# EAGLE board yrl040-bugfix1 (EAGLE 9.4.2), part 2 of 2
## Tracks (layer width: path | path; a pad name or v marks a point on that pad's centre or on a via) (continued)
LED_TX  (via drill 0.35 pad 0.65) (continued)
  Bottom 0.15: IC1.22 v45.8,71.75 | v45.8,71.75 | v15.4,84.9 14.6,84.1 14.6,83.7 15.44,82.86 17.39,82.86 17.52,82.73 17.52,81.19 17.39,81.06 13.34,81.06 12.78,80.5 12.1,80.5 11.4,79.8 11.4,79.75 11.1,79.45 11.1,77.32 11.31,77.1 11.31,76.64 11.4,76.55 11.4,75.6 10.5,74.7 10.5,70.9 11.7,69.7 14.4,69.7 14.43,69.72 15.39,69.72 16.14,70.47 17.09,70.47 17.23,70.61 17.23,71.29 16.79,71.72 16.62,71.72 LED10.2_RED-CATHODE
MISO
  Top 0.15: J19.MISO 10.91,84.5 10.01,85.4 9.26,85.4 8.74,84.87 8.74,84.84 7.4,83.5 6.79,83.5 5.47,82.17 3.17,82.17 0.62,79.62 0.62,59.15 1.73,58.05 1.73,56.62 1.23,56.12 1.23,50.35 1.87,49.7 11,49.7 11.55,49.15 11.55,48.08 10.88,47.42 10.88,46.66 10.06,45.83 J1.MISO
MOSI
  Top 0.15: J19.MOSI 13.08,82.86 13.08,84.87 12.45,85.5 10.33,85.5 10.13,85.7 9.14,85.7 8.94,85.5 6.5,85.5 5.92,84.92 5.92,83.92 5.47,83.47 5.47,82.61 5.34,82.47 3.05,82.47 0.33,79.75 0.33,59.03 1.43,57.93 1.43,56.75 0.93,56.25 0.93,49.7 1.22,49.4 3.02,49.4 4.92,47.5 6.7,47.5 7.2,47 7.2,46.62 7.65,46.17 8.8,46.17 8.87,46.25 9.31,46.25 J1.MOSI
MOTOR_FAULT_LED_C
  Bottom 0.15: 44.5,40.98 44.76,40.73 45.94,40.73 46.08,40.86 46.08,40.98 47.7,42.6 49.05,42.6
  Bottom 0.2: R27.1 49.05,42.6 | U13.19 33.23,39.33 34.1,40.2 34.1,41.9 36.68,44.48 39.12,44.48 39.25,44.35 43,44.35 43.45,43.9 43.45,42.8 43.95,42.3 44.25,42.3 44.5,42.05 44.5,40.98
N$1
  Bottom 0.15: LED1.ANODE 17.77,13.78 17.56,13.78 16.82,13.03 16.82,10.46 17.62,9.65 26.21,9.65 27.08,10.53 27.09,10.53 27.64,11.07 34.5,11.07 34.51,11.08 35,11.08 RA5.P$8
N$2
  Bottom 0.15: RA5.P$7 33.84,12.06 33.84,12.19 33.4,12.62 32.17,12.62 31.65,12.1 27.94,12.1 27.61,12.42 27.61,14.37 26.96,15.03 22.41,15.03 21.48,14.1 LED2.ANODE
N$3
  Bottom 0.15: RA5.P$6 33.03,12.06 33.03,12.19 32.9,12.32 32.3,12.32 31.77,11.8 27.82,11.8 27.32,12.3 27.32,14.24 26.83,14.72 24.65,14.72 24.02,14.1 LED3.ANODE
N$4
  Bottom 0.15: LED4.ANODE 26.07,13.78 26.27,13.78 27.02,13.03 27.02,11.79 27.3,11.5 32.4,11.5 RA5.P$5
N$5
  Bottom 0.15: R4.2 13.8,12 13.5,11.7 13.5,11.06 13.22,10.79 12.25,10.79 U3.3
N$6
  Bottom 0.15: R5.2 14.35,8.71 14.95,9.31 14.95,10.89 14.82,11.03 14.08,11.03 13.36,10.3 13.36,10.26 13.22,10.13 12.23,10.13 U3.4
N$7
  Bottom 0.15: R4.1 C4.2
N$8
  Bottom 0.15: R5.1 C5.2
N$9
  Bottom 0.15: C5.1 13.05,8.2 R2.2 C2.2 11.55,5.3 R1.2
N$10
  Bottom 0.35: U3.5 7.42,9.94 6.93,9.45 5.37,9.45 4.92,9.9 X1.1
N$11
  Bottom 0.29: U7.2 7.02,33.11 7.03,33.1 5.68,33.1 R11.2
  Bottom 1.016: R11.2 R13.2
N$12
  Top 0.508: J8.P1-A J8.P1-B J8.P1-C
  Bottom 0.29: U7.1 7.5,34.83 7.86,34.47 J8.P1-B
N$13
  Top 0.508: J8.P2-A J8.P2-B J8.P2-C
  Bottom 0.406: U7.3 6.51,37.08 6.37,36.94 4.18,36.94 J8.P2-A
N$14
  Bottom 0.29: U8.2 7.02,18.87 7.03,18.86 5.68,18.86 R12.2
  Bottom 1.016: R12.2 R14.2
N$15
  Top 0.508: J9.P1-A J9.P1-B J9.P1-C
  Bottom 0.29: U8.1 7.5,20.59 7.86,20.23 J9.P1-B
N$16
  Top 0.508: J9.P2-A J9.P2-B J9.P2-C
  Bottom 0.406: U8.3 6.51,22.84 6.37,22.7 4.18,22.7 J9.P2-A
N$17
  Bottom 0.35: U3.8 7.42,11.87 6.93,12.35 5.37,12.35 4.92,11.9 X1.2
N$18
  Bottom 0.15: MIC1.1 15.7,17.96 R8.2
N$19
  Bottom 0.15: MIC1.4 10.15,17.05 10.04,16.94 10.04,14.69 R9.2
N$20
  Bottom 0.15: U5.6 24.27,50.16 24.5,50.4 29.27,50.4 29.51,50.16 29.64,50.16 RA6.P$1
N$21
  Bottom 1.5: J7.V_EXT 27.5,65.43 27.48,65.41 27.48,64.39 27.5,64.37 J7.V_INT_JUMPER J7.V+4 J7.V+3 J7.V+2 18.43,63.5 18.41,63.48 17.39,63.48 17.37,63.5 J7.V+1
N$22
  Bottom 1.5: J7.V+5 J7.V+6 J7.V+7 J7.V+8 J7.V_INT_JUMPER1 J7.V_EXT1
N$23
  Bottom 0.29: U9.2 48.88,25.29 48.87,25.3 50.22,25.3 R15.2
  Bottom 1.016: R15.2 R17.2
N$24
  Top 0.508: J16.P1-A J16.P1-B J16.P1-C
  Bottom 0.29: U9.1 48.4,23.57 48.04,23.93 J16.P1-B
N$25
  Top 0.508: J16.P2-A J16.P2-B J16.P2-C
  Bottom 0.406: U9.3 49.39,21.32 49.53,21.46 51.72,21.46 J16.P2-A
N$26
  Bottom 0.29: U10.2 48.88,39.53 48.87,39.54 50.22,39.54 R16.2
  Bottom 1.016: R16.2 R18.2
N$27
  Top 0.508: J17.P1-A J17.P1-B J17.P1-C
  Bottom 0.29: U10.1 48.4,37.81 48.04,38.17 J17.P1-B
N$28
  Top 0.508: J17.P2-A J17.P2-B J17.P2-C
  Bottom 0.406: U10.3 49.39,35.56 49.53,35.7 51.72,35.7 J17.P2-A
N$29
  Bottom 0.15: U5.7 23.6,49.41 23.6,50.4 23.9,50.7 29.5,50.7 29.6,50.6 RA6.P$2
N$30
  Bottom 0.15: U5.8 22.97,50.5 23.47,51 29.47,51 29.51,51.03 29.64,51.03 RA6.P$3
N$31
  Bottom 0.15: U5.9 22.57,49.61 22.57,50.52 23.35,51.3 28.97,51.3 29.87,52.2 RA6.P$4
N$32  (via drill 0.35 pad 0.65)
  Top 0.15: J7.PWM4 24.95,66.7 24.95,66.92 26.5,68.47 28.78,68.47 29.8,67.45 31.42,67.45 31.86,67.89 37.76,67.89 39.22,66.43 39.22,60.15 39.06,60 32.88,60 31.8,58.92 31.8,57.18 32.85,56.13 32.85,52.45 v32.6,52.2
  Bottom 0.15: v32.6,52.2 RA6.P$5
N$33
  Bottom 0.15: MIC1.6 14.15,18.55 R10.1
N$34  (via drill 0.35 pad 0.65)
  Top 0.15: v32.6,51.4 33.15,51.95 33.15,56.25 32.1,57.3 32.1,58.8 33,59.7 39.19,59.7 39.52,60.03 39.52,66.55 37.88,68.19 31.74,68.19 31.3,67.75 29.92,67.75 28.91,68.77 25.71,68.77 22.94,66 21.81,66 J7.PWM3
  Bottom 0.15: v32.6,51.4 RA6.P$6
N$35  (via drill 0.35 pad 0.65)
  Top 0.15: v32.6,50.6 32.7,50.7 32.7,50.72 33.45,51.47 33.45,56.71 34.14,57.4 34.14,58.84 34.7,59.4 39.31,59.4 39.82,59.91 39.82,66.68 38.01,68.49 31.61,68.49 31.17,68.05 30.05,68.05 29.03,69.06 23.47,69.06 20.44,66.04 J7.PWM2
  Bottom 0.15: v32.6,50.6 RA6.P$7
N$36  (via drill 0.35 pad 0.65)
  Top 0.15: v32.6,49.8 32.6,49.82 33.75,50.97 33.75,56.59 34.44,57.27 34.44,58.71 34.82,59.1 39.44,59.1 40.12,59.78 40.12,66.8 38.12,68.8 31.5,68.8 31.05,68.35 30.17,68.35 29.16,69.36 21.07,69.36 18.35,66.65 18.35,66.57 17.82,66.04 J7.PWM1
  Bottom 0.15: v32.6,49.8 RA6.P$8
N$37
  Bottom 0.15: U5.10 21.42,49.64 21.42,50.21 20.33,51.3 18.4,51.3 18,51.7 RA7.P$1
N$38
  Bottom 0.15: U5.11 21.01,50.11 20.12,51 17.4,51 RA7.P$2
N$39
  Bottom 0.15: U5.12 20.38,50.32 20,50.7 18.75,50.7 18.38,50.33 18.38,50.2 18.28,50.1 RA7.P$3
N$40
  Bottom 0.15: U5.13 19.72,50.28 19.6,50.4 18.87,50.4 18.68,50.21 18.68,49.48 18.5,49.3 RA7.P$4
N$41  (via drill 0.35 pad 0.65)
  Top 0.15: J7.PWM8 37.42,65.18 36.21,65.18 35.53,64.5 30.02,64.5 28.73,65.8 28.73,66.55 28.01,67.27 26.99,67.27 26.27,66.55 26.27,65.41 25.25,64.38 25.25,63.11 24.7,62.56 19.05,62.56 18.7,62.21 18.7,62.17 18.29,61.77 18.29,57.4 19.3,56.39 19.3,52.4 18.15,51.25 16.45,51.25 v14.5,49.3
  Bottom 0.15: v14.5,49.3 RA7.P$5
N$42  (via drill 0.35 pad 0.65)
  Top 0.15: v14.5,50.1 16.05,51.65 17.95,51.65 19,52.7 19,56.27 17.99,57.27 17.99,61.89 18.29,62.19 18.29,63.89 18.84,64.44 19.04,64.44 19.1,64.5 24.95,64.5 25.85,65.4 25.85,66.54 26.87,67.56 28.13,67.56 29.02,66.67 29.02,66.25 29.04,66.24 29.04,65.91 30.15,64.8 34.5,64.8 J7.PWM7
  Bottom 0.15: v14.5,50.1 RA7.P$6
N$43  (via drill 0.35 pad 0.65)
  Top 0.15: v14.5,50.9 15.5,51.9 15.5,63.64 16.67,64.8 17.23,64.8 17.67,65.25 18.13,65.25 18.57,64.8 24.82,64.8 25.55,65.53 25.55,66.67 26.74,67.86 28.34,67.86 29.72,66.48 29.72,65.65 30.27,65.1 32.26,65.1 J7.PWM6
  Bottom 0.15: v14.5,50.9 RA7.P$7
N$44  (via drill 0.35 pad 0.65)
  Top 0.15: v14.5,51.7 14.85,52.05 14.85,56.98 15.02,57.15 15.02,63.58 16.54,65.1 17.1,65.1 17.55,65.55 18.25,65.55 18.7,65.1 24.7,65.1 25.25,65.65 25.25,66.79 26.62,68.17 28.66,68.17 29.68,67.15 30.2,67.15 30.66,66.69 J7.PWM5
  Bottom 0.15: v14.5,51.7 RA7.P$8
N$45
  Bottom 0.15: RA8.P$4 17.95,56.25 20.38,56.25 20.62,56.48 23.01,56.48 J7.PWM12
N$46
  Bottom 0.15: RA8.P$3 16.7,56.25 17,56.55 20.26,56.55 20.49,56.78 20.77,56.78 J7.PWM11
N$47
  Bottom 0.15: J7.PWM10 18.02,57.78 17.08,56.85 16.5,56.85 15.9,56.25 RA8.P$2
N$48
  Bottom 0.15: J7.PWM9 15.98,57.78 15.1,56.9 RA8.P$1
N$49
  Bottom 0.15: U5.15 17.85,55.22 17.8,55.17 15.38,55.17 15.1,54.9 RA8.P$8
N$50
  Bottom 0.15: U5.16 19.49,54.99 19.49,54.39 19.36,54.26 18.81,54.26 18.68,54.39 18.68,54.82 18.6,54.9 17.95,54.9 17.93,54.88 16.18,54.88 15.9,54.6 RA8.P$7
N$51
  Bottom 0.15: U5.17 20.61,55.45 20.61,56.05 20.74,56.18 24.03,56.18 25.25,57.4 25.25,58.17 24.7,58.72 16.3,58.72 14.8,57.22 14.8,56.43 14.66,56.29 14.66,53.51 14.8,53.38 16.2,53.38 16.34,53.51 16.34,53.63 RA8.P$6
N$52
  Bottom 0.15: U5.18 20.78,54.99 20.78,54.39 20.35,53.96 18.69,53.96 18.65,54 RA8.P$5
N$53
  Bottom 0.15: RA9.P$4 32.85,56.55 35.83,56.55 37.07,57.78 J7.PWM16
N$54
  Bottom 0.15: RA9.P$3 31.86,56.37 31.86,56.49 32.22,56.85 33.59,56.85 34.53,57.78 J7.PWM15
N$55
  Bottom 0.15: RA9.P$2 31.07,56.37 31.07,56.49 32.36,57.78 J7.PWM14
N$56
  Bottom 0.15: RA9.P$1 29.9,57.02 J7.PWM13
N$57
  Bottom 0.15: U5.19 21.67,53.63 22.47,52.83 22.95,52.83 22.97,52.85 23.43,52.85 23.45,52.83 24.57,52.83 24.87,52.53 27.63,52.53 27.93,52.83 28.53,52.83 RA9.P$8
N$58
  Bottom 0.15: RA9.P$7 30.34,54.56 30.34,54.69 30.2,54.83 29.6,54.83 29.46,54.69 29.46,54.19 28.41,53.13 27.8,53.13 27.5,52.83 25,52.83 24.7,53.13 23.57,53.13 23.55,53.15 22.85,53.15 22.34,53.66 U5.20
N$59
  Bottom 0.15: RA9.P$6 31.14,54.56 31.14,54.69 30.86,54.96 30.49,54.96 30.33,55.12 29.47,55.12 29.16,54.82 29.16,54.31 28.28,53.43 27.68,53.43 27.38,53.13 25.12,53.13 24.82,53.43 23.69,53.43 23.68,53.45 23.55,53.45 22.97,54.03 U5.21
N$60
  Bottom 0.15: RA9.P$5 32.73,54.63 32.73,56 32.98,56.25 35.95,56.25 36.55,56.85 38.67,56.85 39.22,57.4 39.22,58.17 38.67,58.72 30.27,58.72 28.86,57.32 28.86,54.66 27.93,53.73 27.56,53.73 27.26,53.43 25.24,53.43 24.94,53.73 24.07,53.73 23.63,54.17 U5.22
N$61
  Bottom 0.15: U13.4 36.88,40.88 37.45,40.88 38.63,42.06 J22.GPIO0
N$62  (via drill 0.35 pad 0.65)
  Top 0.15: v37.59,40.01 37.59,41.09 38.2,41.7 39.69,41.7 J22.GPIO1
  Bottom 0.15: U13.5 37.55,39.97 v37.59,40.01
N$63
  Bottom 0.15: U13.6 36.65,39.3 37.66,39.3 38.63,40.27 J22.GPIO2
N$64
  Bottom 0.15: U13.7 37.87,38.67 38.24,39.04 39.57,39.04 J22.GPIO3
N$65
  Bottom 0.15: J22.GPIO4 38.56,38.03 U13.8
N$66
  Bottom 0.15: J22.GPIO5 40.23,37.16 38.24,37.16 38.03,37.37 U13.9
N$67
  Bottom 0.15: U13.10 37.89,36.71 38.63,35.97 J22.GPIO6
N$68
  Bottom 0.15: J22.GPIO7 40.23,34.62 38.24,34.62 37.69,35.17 37.69,35.9 37.51,36.08 U13.11
N$69
  Bottom 0.9: F2.1 42.2,60.77 J7.+5V1
N$70
  Bottom 0.6: J7.+5V 28.3,60.7 F1.1
N$71
  Bottom 0.2: R27.2 48.65,43.9 LED8.CATHODE
N$72
  Bottom 0.152: R25.2 51.45,53.48 51.1,53.48 50.9,53.48 LED7.CATHODE
N$73
  Bottom 0.152: R25.1 52.96,53.29 Q1.3-D
  Bottom 1.016: Q1.3-D 51.87,51.85 51.29,51.85 50.54,51.1 J23.V-
N$74
  Bottom 0.2: LED7.ANODE 47.26,51.47 J23.V+
  Bottom 0.813: F4.2 49.4,49.33 J23.V+
N$75
  Bottom 0.152: R31.2 43.25,53.48 LED12.CATHODE
N$76
  Bottom 0.152: R31.1 44.96,53.49 Q2.3-D
  Bottom 1.016: Q2.3-D 43.87,51.85 43.29,51.85 42.54,51.1 J24.V-
N$77
  Bottom 0.2: LED12.ANODE 39.26,51.47 J24.V+
  Bottom 0.813: F5.2 41.4,49.33 J24.V+
N$78
  Bottom 0.2: RA11.P$6 6,66.6 6.55,66.6 7.26,67.31 7.83,67.31 7.97,67.16 7.97,66.55 U14.9
N$79
  Bottom 0.2: U14.10 8.63,66.53 8.63,67.16 8.14,67.66 6.56,67.66 6.21,67.3 RA11.P$5
N$80
  Bottom 0.2: U14.11 9.4,66.42 9.4,67.03 8.42,68.01 7.69,68.01 RA12.P$8
N$81
  Bottom 0.2: U14.12 10.16,66.93 8.94,68.14 8.78,68.14 8.57,68.36 7.84,68.36 6.55,69.64 6.55,70.11 6.4,70.26 6.24,70.26 RA12.P$7
N$82
  Bottom 0.2: U14.13 10.79,66.95 9.38,68.38 9.28,68.47 9.11,68.47 8.88,68.71 7.98,68.71 6.9,69.79 6.9,70.56 6.06,71.4 RA12.P$6
N$83
  Bottom 0.2: U14.14 11.46,66.93 9.33,69.06 8.13,69.06 7.25,69.94 7.25,70.9 6.69,71.46 6.69,71.69 6.18,72.2 RA12.P$5
N$84
  Bottom 0.2: U14.8 6.92,65.7 RA11.P$7
N$85
  Bottom 0.15: U15.27 9.2,49.69 9.2,49.51 9.04,49.35 7.95,49.35 7.75,49.55 7.75,49.9 7.7,49.9 6.6,51 6.6,51.3 X5.P$1 5.2,51.3 C34.P$2
N$86
  Bottom 0.15: U15.26 9.7,49.69 9.7,49.51 9.24,49.05 7.83,49.05 7.45,49.43 7.45,49.45 7.2,49.7 X5.P$2 6.4,49.8 C35.P$2
N$87
  Bottom 0.15: C38.P$2 5.63,53.3 6.41,54.08 7.66,54.08 8.24,53.5 9.8,53.5 9.85,53.45 U15.9
N$88
  Bottom 0.15: X3.1 35.3,79.47 35.3,78.7 36.04,77.96 IC2.7
N$89
  Bottom 0.15: IC2.8 37.63,78.24 X3.3
N$90
  Bottom 0.15: C27.1 47.58,80.1 47.34,79.86 46.16,79.86 45.26,78.96 43.05,78.96 42.55,78.46 IC1.2
N$91
  Bottom 0.15: R19.2 4.25,75.63 VR1.P$3
N$92
  Bottom 0.15: RA13.P$7 12.75,72 LED10.1-RED_ANODE
N$93
  Bottom 0.15: RA13.P$8 12.65,71.2 LED10.3-GREEN-ANODE
N$94
  Bottom 0.15: LED11.3-GREEN-ANODE 12.65,73.85 12.22,73.42 12.22,73.3 12.09,73.17 11.96,73.17 RA13.P$6
N$95
  Bottom 0.15: RA13.P$5 12.18,74.17 12.18,74.19 12.73,74.75 LED11.1-RED_ANODE
N$96
  Bottom 0.15: LED9.3-GREEN-ANODE 12.05,76.75 11.91,76.89 11.91,77.35 11.7,77.57 11.7,79.2 12,79.5 R28.1
N$97
  Bottom 0.15: LED9.1-RED_ANODE 13.21,77.65 14.13,78.58 17.98,78.58 R29.1
POWERFAULT_LED  (via drill 0.35 pad 0.65)
  Top 0.15: v31.91,9.6 36.2,13.88 36.2,22.82 35.32,23.7 32.1,23.7 v32,23.6 | v35.4,30.4 35.4,33.1 v35.3,33.2 | v37.1,43.9 33.69,43.9 31.47,46.12 30.58,46.12 30.35,46.35 29.52,46.35 29.29,46.12 28.71,46.12 28.18,46.66 28.18,46.85 23.2,51.83 v23.2,52.3 | v18.2,52.7 17.69,53.21 17.69,64.49 v17.9,64.7 | v17.8,66.8 17.8,74 v21.3,77.5
  Bottom 0.15: U4.20 36.29,4.47 35.69,4.47 32.35,7.81 32.35,9.03 31.91,9.46 v31.91,9.6 | v32,23.6 32,27 v35.4,30.4 | v37.1,43.9 36.18,42.98 35.79,42.98 35.3,42.49 v35.3,33.2 | v23.2,52.3 18.6,52.3 v18.2,52.7 | v17.9,64.7 17.8,64.8 v17.8,66.8 | LED9.2_RED-CATHODE 16.65,77.5 17.68,77.5 18.36,76.83 19.64,76.83 20.32,77.5 v21.3,77.5
RESET  (via drill 0.35 pad 0.65)
  Top 0.15: v29.57,39.4 29.57,39.99 30.38,40.8 30.38,41.95 30,42.34 v30,45.5 | v35.5,53.3 SW6.1
  Bottom 0.15: U13.20 30.55,39.73 29.95,39.73 29.62,39.4 v29.57,39.4 | v30,45.5 30,47.17 30.66,47.83 31.62,47.83 35.5,51.7 v35.5,53.3
RX
  Bottom 0.15: RA10.P$7 24.04,78.86 24.04,78.99 23.9,79.12 23.3,79.12 23.16,78.99 23.16,78.77 22.45,78.05 22.45,75.1 SW5.B_COM
RX_SERVO
  Bottom 0.15: U12.3 49.35,64.65 49.12,64.42 47.17,64.42 46.9,64.7 43.42,64.7 42.99,65.13 42.99,66.67 42.07,67.6 40.87,67.6 40.67,67.4 33.78,67.4 33.58,67.6 28.95,67.6 28.38,68.17 27.59,68.17 27.45,68.31 27.45,69.9 27.06,70.29 27.06,70.84 27.55,71.33 27.55,72.07 27.02,72.6 26.28,72.6 25.38,71.7 SW5.B_2
RX_USB  (via drill 0.35 pad 0.65)
  Top 0.15: SW5.B_1 25.75,74.3 25.75,73.83 26.28,73.3 26.32,73.3 27.75,71.87 27.75,71.75 28.25,71.25 29.02,71.25 30.22,70.05 31.18,70.05 31.43,70.3 32.48,70.3 32.67,70.5 33.83,70.5 v34.01,70.69
  Bottom 0.15: IC1.1 41.9,77 41.05,76.15 41.05,72.7 40.7,72.35 40.7,71.49 39.06,69.85 37.6,69.85 37.47,69.98 37.47,70.21 35.28,72.4 34.1,72.4 34.01,72.31 v34.01,70.69
RXD  (via drill 0.35 pad 0.65)
  Top 0.15: v6.35,46.65 6.41,46.65 6.6,46.46 6.6,46.38 7.52,45.45 7.61,45.45 J1.RXD
  Bottom 0.15: R22.P$1 6.3,46.6 v6.35,46.65 | v6.35,46.65 6.63,46.94 6.63,47.59 7.47,48.42 9.55,48.42 10.5,49.38 12.57,49.38 12.7,49.51 12.7,49.69 U15.20 | v6.35,46.65
SCL0
  Bottom 0.15: RA3.P$3 26.1,40.6 25.27,39.77 U2.5 21.46,39.77 20.44,38.74 20.44,34.58 18.6,32.73 18.6,32.57 J2.SCL_3 17.54,31.5 J2.SCL_1
SCL1
  Bottom 0.15: RA3.P$1 26,39 25.47,38.47 U2.7 23.6,38.47 22.1,36.97 22.1,34.4 24.4,32.1 25.53,32.1 | 25.53,32.1 J3.SCL_3 | J3.SCL_1 24.93,31.5 25.53,32.1
SCL2
  Bottom 0.15: RA4.P$3 26,36.9 25.73,37.17 U2.9 24.39,37.2 23.6,37.2 22.72,36.32 22.72,34.62 24.01,33.34 30.5,33.34 31.7,32.14 J4.SCL_3 32.34,31.5 J4.SCL_1
SCL3
  Bottom 0.15: RA4.P$1 25.9,35.3 25.32,35.88 U2.11 23.7,35.88 23.32,35.5 23.32,34.92 24.31,33.94 32.87,33.94 34.17,32.64 34.17,32.5 34.47,32.2 34.73,32.2 34.84,32.09 36.51,32.09 37.46,33.04 39.47,33.04 J5.SCL_3 39.73,31.5 J5.SCL_1
SCL4  (via drill 0.35 pad 0.65)
  Top 0.15: v16.75,35.72 16.9,35.87 16.9,41.7 16.89,41.72 16.89,45.34 16.4,45.83 15.28,45.83 14.9,46.2 14.9,48.92 15.05,49.07 15.05,49.43 16.32,50.7 19.6,50.7 v25.7,56.8 25.25,57.25 25.25,58.17 23.7,59.72 23.38,59.72 23.07,60.03 23.07,61.89 23.45,62.26 24.82,62.26 25.55,62.99 25.55,64.2 26.16,64.81 28.01,64.81 28.09,64.9 v28.7,64.9 | J19.A5 38.33,81.96 37.43,81.06 36.76,81.06 33.75,78.05 33.75,72 32.35,70.6 31.3,70.6 31.05,70.35 30.35,70.35 29.85,70.85 29.85,71.2 29.65,71.4 29.3,71.4 29.15,71.55 28.37,71.55 28.05,71.87 28.05,72.65 v28.4,73
  Bottom 0.15: U2.14 18.56,35.9 16.9,35.9 16.6,35.6 RA2.P$7 16.64,35.6 v16.75,35.72 | U5.26 26.22,56.28 v25.7,56.8 | IC2.28 29.2,72.75 28.95,73 v28.4,73 28.3,72.9 28.22,72.9 27.92,73.2 26.03,73.2 25.83,73 22.95,73 22.15,72.2 22.15,71.2 22.85,70.5 23.85,70.5 24.15,70.8 25.28,70.8 26.35,69.73 26.35,67.83 26.91,67.27 28.01,67.27 28.73,66.55 28.73,65.53 28.7,65.51 v28.7,64.9
SCL5  (via drill 0.35 pad 0.65)
  Top 0.15: v15.44,37.2 15.44,44.46 15.23,44.66 15.23,45.42 14.48,46.17 13.72,46.17 13.23,46.66 13.23,54.95 J6.SCL
  Bottom 0.15: U2.16 18.55,37.2 RA2.P$5 v15.44,37.2
SCL6  (via drill 0.35, 0.35 pad 0.65, 0.45 pad 0.75)
  Top 0.15: v10.07,24.13 12.93,24.13 14.32,25.52 v14.32,27.57 19.13,27.57 19.15,27.55 19.85,27.55 19.87,27.57 40.33,27.57 40.7,27.2 40.7,20.3 41.7,19.3 v44.1,19.3 44.2,19.1 44.2,16.37 44.8,15.77 44.8,15.03 44.2,14.43 44.2,1.3 43.52,0.62 35.98,0.62 35.3,1.3 v35.3,2.9 | v29.5,40.7 29.5,40.79 30.08,41.37 30.08,41.83 29.76,42.15 29.3,42.15 28.45,41.3 24.55,41.3 21.22,37.96 20.76,37.96 20.31,38.41 v19.59,38.41 | v8.7,43.09 9.21,43.6 10.44,43.6 10.88,44.05 10.88,45.34 10.76,45.46 10.76,46.11 11.19,46.53 11.19,47.29 11.85,47.96 11.85,49.28 9.48,51.65 9.48,57.69 v11.01,59.22
  Top 0.152: v10.1,39.1 v11.5,39.1 | v45.4,19.3 v44.1,19.3
  Bottom 0.15: RA1.P$7 16.6,39.3 17.43,38.47 U2.18 | U6.14 36.62,14.04 36.71,13.95 43.85,13.95 44.9,15 44.9,18.5 v44.1,19.3 44.1,20.82 44.27,20.99 44.27,25.32 45.3,26.35 | v14.32,27.57 14.32,32.1 15.62,33.4 18.42,33.4 19.84,34.82 19.84,37.81 19.41,38.24 18.81,38.24 U2.18 | U8.10 7.8,28.85 8.49,28.16 9.8,28.16 10.33,27.63 10.33,24.4 v10.07,24.13 | U4.22 35.31,2.91 v35.3,2.9 | 11.06,38.7 11.46,39.1 v11.5,39.1 | U13.22 30.09,41.29 v29.5,40.7 | v19.59,38.41 18.63,38.41 U2.18 | U14.2 10.79,59.44 v11.01,59.22 | 10.61,38.24 10.46,38.1 10.46,32.78 8.93,31.24 8.93,30.37 8.62,30.07
  Bottom 0.152: U7.10 v8.7,43.09 9.71,43.09 10.1,42.7 v10.1,39.1 | 11.06,38.7 10.61,38.24 | U8.10 7.5,29.55 8.02,30.07 8.62,30.07 | U9.10 46.19,15.31 45.5,16 45.5,18.82 45.5,18.83 45.5,19.3 v45.4,19.3 | U10.10 48.4,28.85 47.88,28.33 47.28,28.33 45.3,26.35
SCL7
  Bottom 0.15: RA1.P$5 16.5,40.9 17.7,39.7 18.51,39.7 U2.20 19.69,39.77 23.35,43.42 24.02,43.42 24.9,44.31 24.9,46.2 25.7,47 J1.SCL_UC
SCL_MASTER
  Bottom 0.15: U2.22 20.16,41.09 23.19,44.11 23.19,46.13 J1.SCL
SCLK
  Top 0.15: J1.SCLK 12.06,47.74 12.15,47.83 12.15,49.4 9.78,51.77 9.78,55.73 10.62,56.57 11.47,56.57 12.04,57.13 12.04,58.97 11.24,59.77 6.43,59.77 6.4,59.75 2.68,59.75 0.93,61.5 0.93,79.5 3.3,81.88 5.74,81.88 6.72,82.86 8.74,82.86 J19.SCLK
SDA0
  Bottom 0.15: RA3.P$4 26.3,41.4 25.33,40.43 U2.4 21.7,40.43 20.14,38.87 20.14,34.7 18.54,33.1 16.59,33.1 J2.SDA_3 15.63,30.23 J2.SDA_1
SDA1
  Bottom 0.15: RA3.P$2 26,39.8 25.33,39.13 U2.6 23.6,39.13 21.8,37.33 21.8,33.37 J3.SDA_3 23.66,31.5 J3.SDA_1
SDA2
  Bottom 0.15: RA4.P$4 26.66,37.84 U2.8 23.6,37.84 22.4,36.63 22.4,34.52 23.88,33.04 25.94,33.04 26.84,32.14 J4.SDA_3 31.07,31.5 J4.SDA_1
SDA3
  Bottom 0.15: RA4.P$2 25.9,36.1 25.49,36.51 U2.10 23.61,36.51 23.02,35.92 23.02,34.8 24.18,33.64 32.74,33.64 33.87,32.51 33.87,32.3 34.27,31.9 34.61,31.9 34.72,31.79 37.48,31.79 J5.SDA_3 38.47,31.5 J5.SDA_1
SDA4  (via drill 0.35 pad 0.65)
  Top 0.15: v16.81,34.91 16.81,34.99 17.3,35.49 17.3,41.72 17.2,41.82 17.2,45.45 16.53,46.12 15.47,46.12 15.2,46.4 15.2,48.8 16.8,50.4 20.1,50.4 22.85,53.15 23.55,53.15 23.85,52.85 25.44,52.85 v26.87,54.28 26.87,56.98 23.82,60.02 23.5,60.02 23.37,60.15 23.37,61.77 23.57,61.96 26.93,61.96 27.2,62.23 28.33,62.23 v28.8,62.7 | v28.6,72.1 29.02,72.1 29.42,71.7 29.77,71.7 30.15,71.32 30.15,70.97 30.47,70.65 30.93,70.65 31.18,70.9 32.23,70.9 33.45,72.12 33.45,79.1 J19.A4
  Bottom 0.15: U2.13 17.03,35.22 16.61,34.8 RA2.P$8 16.69,34.8 v16.81,34.91 | U5.27 26.87,55.21 v26.87,54.28 | IC2.27 29.4,71.95 29.25,72.1 v28.6,72.1 28.25,72.45 28.17,72.45 27.72,72.9 26.15,72.9 25.95,72.7 23.08,72.7 22.45,72.07 22.45,71.33 22.98,70.8 23.72,70.8 24.02,71.1 25.4,71.1 26.85,69.65 26.85,68.06 27.34,67.56 28.13,67.56 29.25,66.45 29.25,64.67 28.8,64.22 v28.8,62.7
SDA5  (via drill 0.35 pad 0.65)
  Top 0.15: v15.4,36.4 14.88,36.91 14.88,45.34 14.35,45.88 13.59,45.88 12.89,46.58 12.89,54.59 12.24,55.23 J6.SDA
  Bottom 0.15: U2.15 18.46,36.4 RA2.P$6 v15.4,36.4
SDA6  (via drill 0.35, 0.35 pad 0.65)
  Top 0.15: v34.4,2.17 34.4,1.3 35.38,0.33 43.65,0.33 44.5,1.18 44.5,4.3 v44.8,4.6 | v9.7,24.9 12.9,24.9 v13.7,25.7 13.7,27.73 14.09,28.12 19,28.12 19.27,27.85 19.73,27.85 20,28.12 40.58,28.12 41.1,27.6 41.1,23 41.25,22.85 41.93,22.85 42.18,22.6 v45,22.6 | v18.5,34.57 24.93,41 28.93,41 v29.53,41.6 | v9.5,58.5 9.2,58.5 8.65,59.05 6.42,59.05 v6.17,58.8 | v6.99,44.6 4.68,46.9 4.67,46.9 2.78,48.8 0.98,48.8 0.33,49.45 0.33,56.85 v0.57,57.1
  Bottom 0.15: U4.23 34.51,2.28 v34.4,2.17 | RA1.P$8 16.7,38.5 17.4,37.8 18.54,37.8 U2.17 18.84,37.58 19.41,37.58 19.54,37.45 19.54,34.95 18.8,34.2 | U6.15 36.43,13.37 36.71,13.65 38,13.65 | U8.9 7.14,28.74 7.14,28.05 7.33,27.86 9.68,27.86 10.03,27.51 10.03,26.01 9.7,25.68 v9.7,24.9 | v13.7,25.7 13.77,25.77 13.77,27.8 14,28.03 14,32.2 15.49,33.7 18.29,33.7 18.8,34.2 | v44.8,4.6 42.5,4.6 40.28,6.82 40.28,10.74 39.59,11.43 38.58,11.43 38.02,11.97 38.02,13.52 38,13.54 38,13.65 | 45.64,26.26 44.56,25.19 44.56,22.6 | 44.56,22.6 44.56,19.68 44.8,19.45 44.8,19.05 45.2,18.65 45.2,14.95 46.5,13.65 | U9.9 48.88,14.38 48.15,13.65 46.5,13.65 | v45,22.6 44.56,22.6 | v18.5,34.57 18.8,34.27 18.8,34.2 | U13.23 29.85,41.92 v29.53,41.6 | v9.5,58.5 v9.51,58.5 10.16,59.15 U14.3 | U7.9 7.02,44.57 v6.99,44.6 | v6.17,58.8 5.62,58.25 2.97,58.25 2.9,58.18 1.65,58.18 v0.57,57.1 | 38,13.65 46.5,13.65
  Bottom 0.152: U7.9 7.02,43.82 7.1,43.9 7.13,43.9 7.27,44.03 7.83,44.03 8.21,43.65 8.93,43.65 9.18,43.4 9.83,43.4 10.4,42.83 10.4,39.72 10.76,39.37 10.76,38.83 10.16,38.23 10.16,32.9 8.63,31.37 8.63,30.51 8.49,30.37 7.85,30.37 7.02,29.55 U8.9 | 45.64,26.26 47.41,28.03 48.06,28.03 48.88,28.85 U10.9
SDA7
  Bottom 0.15: RA1.P$6 16.6,40.1 17.57,39.13 U2.19 19.48,39.13 23.47,43.12 24.14,43.12 24.89,43.88 24.93,43.88 J1.SDA_UC
SDA_MASTER
  Bottom 0.15: J1.SDA 24.06,45.83 24.89,46.66 24.89,47.34 24.4,47.83 23.72,47.83 22.89,46.99 22.89,44.23 20.35,41.7 18.6,41.7 U2.23
SENSOR0
  Bottom 0.15: U6.1 28.1,12.71 27.91,12.9 27.91,14.49 27.08,15.32 20.57,15.32 19.6,16.3 19.6,19.5 18.4,20.7 J10.1-VO
SENSOR1
  Bottom 0.15: U6.2 28.44,13.37 28.21,13.6 28.21,14.62 27.21,15.62 21.9,15.62 20.1,17.43 J11.1-VO
SENSOR2
  Bottom 0.15: J12.1-VO 25,16.93 26,15.93 27.33,15.93 28.72,14.54 28.72,14.4 29.08,14.04 U6.3
SENSOR3
  Bottom 0.15: J13.1-VO 28.29,19.09 28.29,18.64 28.1,18.45 28.1,15.58 29.01,14.67 U6.4
SENSOR4
  Bottom 0.15: U6.5 28.77,15.33 28.4,15.7 28.4,18.32 29.58,19.5 31.04,19.5 31.44,19.9 34,19.9 J14.1-VO
SENSOR5
  Bottom 0.15: J15.1-VO 36.6,20.7 35.65,19.75 35.25,19.75 35.1,19.6 31.57,19.6 31.17,19.2 29.7,19.2 28.7,18.2 28.7,16.1 28.84,15.96 U6.6
SERIAL_SERVO  (via drill 0.35 pad 0.65)
  Top 0.15: v48,66.1 48,62.6 J21.P$3
  Bottom 0.15: U12.6 U12.5 48.85,66.95 v48,66.1
  Bottom 0.2: J21.P$3 48.1,61 51.15,57.95 R20.1
SW1  (via drill 0.35 pad 0.65)
  Top 0.152: v18.1,3.6 SW1.1
  Bottom 0.15: 20.16,3.06 19.65,3.57 19.2,3.57 | 20.6,2.75 23.36,2.75 23.5,2.9
  Bottom 0.152: v18.1,3.6 18.13,3.57 19.2,3.57 | 20.6,2.75 20.47,2.75 20.16,3.06 | U4.4 29.51,3.57 29.01,3.08 23.68,3.08 23.5,2.9
SW2  (via drill 0.35 pad 0.65)
  Top 0.152: v20.7,3.3 20.7,1.57 SW1.2
  Bottom 0.15: 23,3.15 20.85,3.15 v20.7,3.3
  Bottom 0.152: U4.5 29.74,4.24 28.89,3.38 23.56,3.38 23.33,3.15 23,3.15
SW3  (via drill 0.35 pad 0.65)
  Top 0.152: v23.1,3.7 23.1,1.57 SW1.3
  Bottom 0.152: U4.6 29.95,4.87 28.76,3.68 23.32,3.68 23.3,3.7 v23.1,3.7
SW4  (via drill 0.35 pad 0.65)
  Top 0.15: SW1.4 27.31,1.5 27.98,0.82 28.92,0.82 29.73,1.64 29.73,4.8 30.16,5.23 v31.89,5.23
  Bottom 0.15: v31.89,5.23 31.59,5.53 U4.7
SW_CN
  Bottom 0.152: SW4.P6 38.35,8.45 38,8.8 36.54,8.8 U4.13
SW_DN  (via drill 0.35 pad 0.65)
  Top 0.152: SW4.P3 28.45,3.37 29.43,4.35 29.43,5.15 29.3,5.28 v29.3,6.38
  Bottom 0.152: v29.3,6.38 29.75,6.83 U4.9
SW_LF  (via drill 0.35 pad 0.65)
  Top 0.152: SW4.P2 28.45,5.5 28.45,6.5 v29.12,7.18
  Bottom 0.152: v29.12,7.18 29.43,7.49 U4.10
SW_PB1  (via drill 0.35 pad 0.65)
  Top 0.15: SW2.P$1 17.72,4 17.87,4.15 22.56,4.15 25.57,7.16 25.57,7.95 27.75,10.13 29.69,10.13 31.72,8.1 v35.3,8.1
  Bottom 0.15: U4.14 35.32,8.12 v35.3,8.1
SW_PB2  (via drill 0.35 pad 0.65)
  Top 0.15: SW3.P$1 38.92,7.08 v38.3,7.08
  Bottom 0.15: v38.3,7.08 37.9,7.47 37.9,7.49 U4.15
SW_RG  (via drill 0.35 pad 0.65)
  Top 0.15: v31.9,7.09 34.24,4.75 34.4,4.75
  Top 0.152: 34.4,4.75 SW4.P5
  Bottom 0.15: v31.9,7.09 31.64,7.35 31.64,7.76 31.28,8.12 U4.11
SW_UP
  Bottom 0.152: U4.8 29.87,6.17 29.53,5.83 29.07,5.83 28.45,6.45 SW4.P1
SWITCH_5V  (via drill 0.35 pad 0.65)
  Top 0.15: v29.6,38 32.28,38 35.88,34.4 41.34,34.4 42.11,35.17 42.11,42.37 42.41,42.67 42.41,43.69 42.11,43.99 42.11,45.19 41.7,45.6 36.62,45.6 36.1,46.12 36.1,46.88 36.62,47.4 54.1,47.4 54.46,47.76 v54.46,49.1
  Bottom 0.15: U13.17 29.64,38.03 v29.6,38 | R23.2 54.42,49.14 v54.46,49.1
  Bottom 0.152: Q1.1-G 53.96,49.27 R23.2
SWITCH_12V  (via drill 0.35 pad 0.65)
  Top 0.15: v32.1,38.6 32.4,38.3 34,36.7 38.9,36.7 40.23,38.03 40.23,41.03 40.78,41.58 40.98,41.58 41.5,42.1 41.5,42.18 42.11,42.79 42.11,43.57 41.81,43.87 41.81,45.07 41.58,45.3 36.5,45.3 35.8,46 35.8,47 36.5,47.7 45.4,47.7 v46.6,48.9
  Bottom 0.15: U13.18 32.03,38.67 v32.1,38.6 | v46.6,48.9 46.07,48.9 R30.2
  Bottom 0.152: Q2.1-G 45.96,49.27 R30.2
SWITCH_INT  (via drill 0.35 pad 0.65)
  Top 0.15: v5.72,44.92 4.68,44.92 4.05,45.55 3.59,45.55 3.27,45.23 3.27,44.87 3.2,44.8 1.88,44.8 v0.57,46.1 | J1.GPIO5 13.48,45.58 13.47,45.58 13.04,46.01 v12.59,46.01
  Bottom 0.15: U4.1 29.89,0.82 27.98,0.82 27.21,1.6 R7.1 26.12,1.6 25.34,2.38 24.16,2.38 22.11,0.33 3.13,0.33 arc-45 1.33,1.07 1.06,1.34 arc-45 0.35,3.05 0.33,3.08 0.33,46.1 v0.57,46.1 | v5.72,44.92 6.53,44.92 7.73,46.12 8.75,46.12 8.87,46.25 9.33,46.25 9.45,46.12 10.53,46.12 10.64,46.01 v12.59,46.01
TX
  Bottom 0.15: RA10.P$8 23.7,78.4 23.7,77.62 24.25,77.07 24.25,76.6 SW5.A_COM
TX_SERVO
  Bottom 0.15: U12.2 49.85,64.45 49.52,64.12 47.05,64.12 46.77,64.4 44.68,64.4 44.58,64.3 43.4,64.3 42.7,65 42.7,66.55 41.94,67.3 41,67.3 40.8,67.1 33.65,67.1 33.45,67.3 28.82,67.3 28.26,67.86 27.47,67.86 27.15,68.18 27.15,69.77 26.65,70.27 SW5.A_2
TX_USB  (via drill 0.35 pad 0.65)
  Top 0.15: v36.65,70.25 34.36,70.25 34.11,70 31.55,70 31.3,69.75 30.1,69.75 29.05,70.8 26.28,70.8 25.45,71.63 25.45,74.18 23.83,75.8 22.98,75.8 22.45,76.33 22.45,77.07 22.98,77.6 25.75,77.6 SW5.A_1
  Bottom 0.15: v36.65,70.25 36.65,70.15 36.7,70.1 36.92,70.1 37.48,69.55 39.18,69.55 41,71.37 41,72.22 41.35,72.58 41.35,76.03 41.52,76.2 43.22,76.2 43.57,75.85 44.03,75.85 44.5,76.32 IC1.5
TXD  (via drill 0.35 pad 0.65)
  Top 0.15: v10.7,48.8 9.86,48.8 J1.TXD 7.63,47 6.83,47.8 6.67,47.8 v6.28,48.18
  Bottom 0.15: v6.28,48.18 6.18,48.12 5.18,48.12 R24.P$1 | v10.7,48.8 11.06,48.8 11.34,49.08 12.77,49.08 13.2,49.51 13.2,50.17 12.91,50.46 U15.19
V_REF
  Bottom 0.254: U6.10 36.88,16.63 C19.1
VARIABLE  (via drill 0.35 pad 0.65)
  Top 0.15: v35.6,18.9 20.4,18.9 17.2,22.1 v17.2,23.6 | v19.5,28.4 19.15,28.4 18.98,28.57 4.5,28.57 4.3,28.37 2.87,28.37 2.55,28.69 2.55,29.15 2.87,29.47 2.99,29.47 v3.73,30.21 | v1.7,32.4 0.93,33.17 0.93,42.38 1.9,43.35 3.73,43.35 4.35,43.97 4.35,44.47 v3.82,45 | v1.77,67.4 6.04,71.66 VR1.P$2 | v2.33,50.25 1.75,50.25 1.52,50.47 1.52,56 2.02,56.5 2.02,58.57 v1.32,59.28
  Bottom 0.15: U6.7 29.94,16.88 30.51,16.88 32.53,18.9 v35.6,18.9 | v17.2,23.6 17.2,27.8 17.8,28.4 v19.5,28.4 | v3.73,30.21 1.7,32.24 v1.7,32.4 | v3.82,45 3.82,45.75 4.03,45.96 4.03,48.84 3.89,48.98 2.76,48.98 2.33,49.41 v2.33,50.25 | v1.77,67.4 1.77,65.99 1.82,65.94 1.82,64.66 1.69,64.53 1.37,64.53 0.93,64.08 0.93,63.8 0.85,63.73 0.85,61.64 2.12,60.37 2.12,59.67 1.8,59.35 1.4,59.35 v1.32,59.28
VDD_SERVO
  Top 0.813: J21.P$2 45.13,62.23 44.54,62.23 43.82,61.51 43.82,60.49 44.25,60.05 45,59.3 45,57.8 X4.1 J20.P$1

## Text on the board
bNames: G / N / D | 12 | 5 | YRL040 - JAH - Sep 2019
Text: All fuses rated 1A Fast Acting / / Current limit necessary due to / limitations of connectors used